# EasyEDA Pro project ProPrj_Avaota A1 八核 AIoT 开发板_2024-05-03.epro, board 点位_TOP (continued)
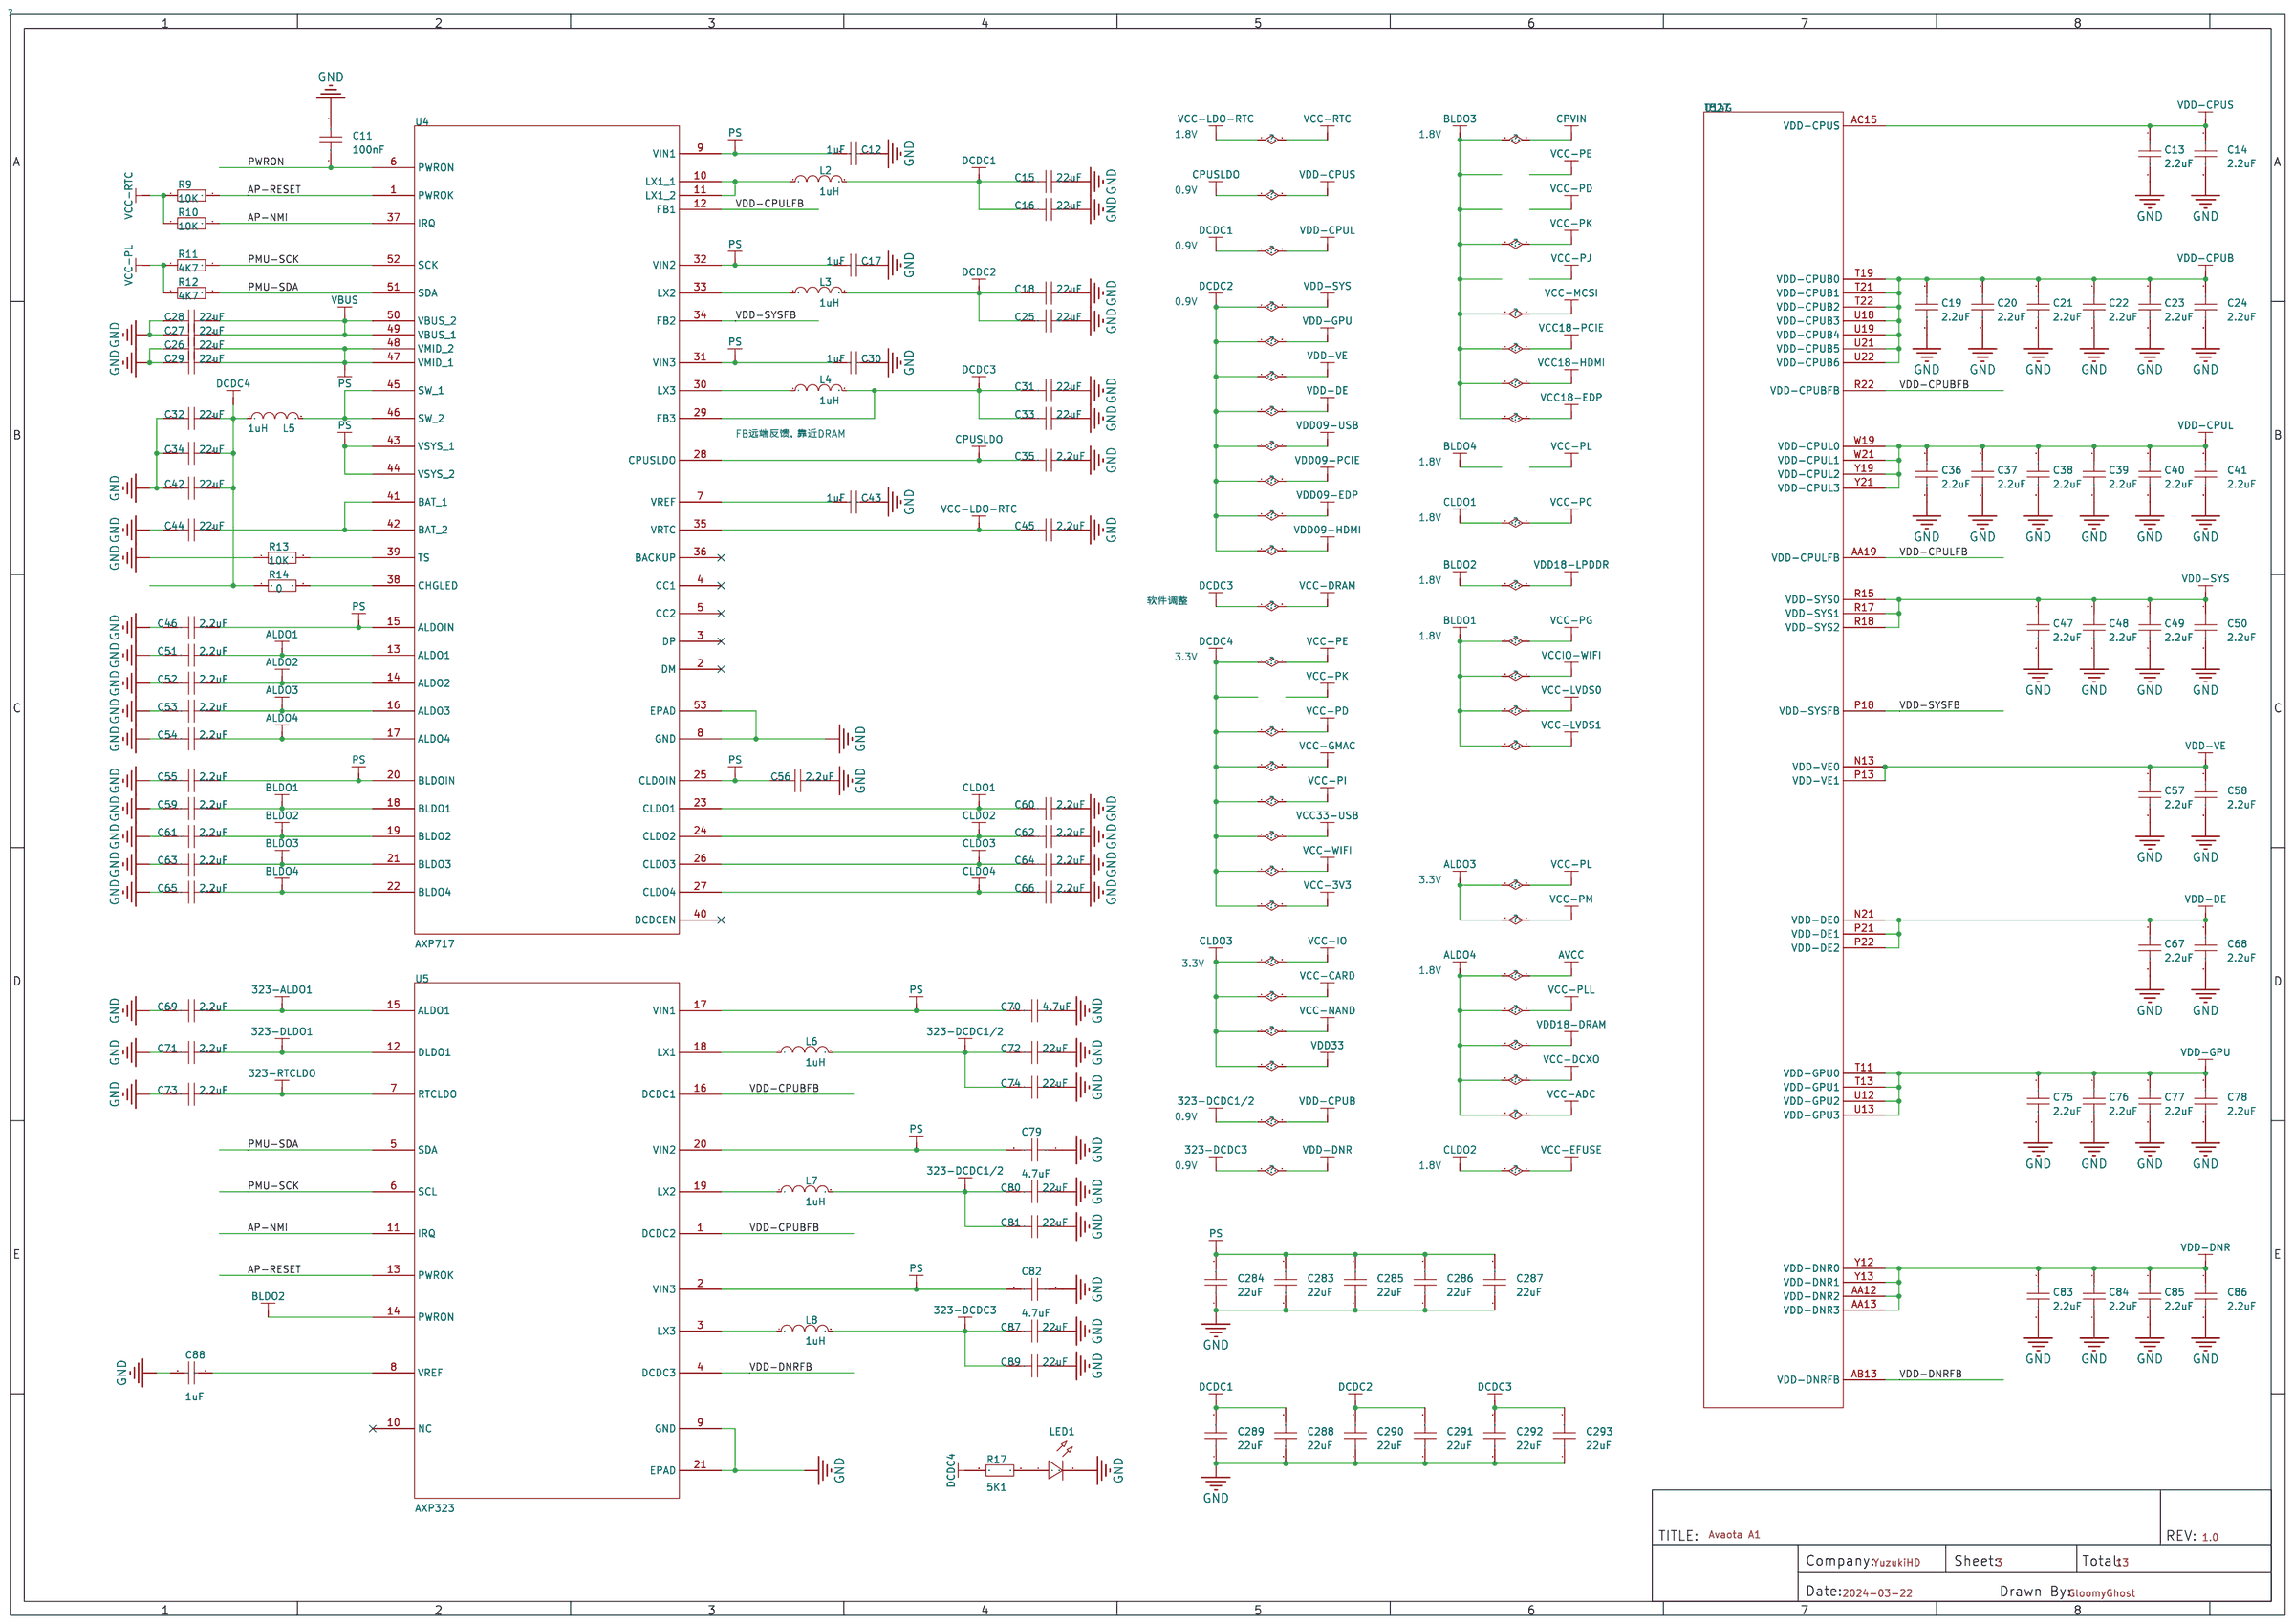
[diagram p0: POWER]
## Routing (per net, layer and track width the routed paths; a pad name or vN(x,y) marks a point on that pad's centre or on a via; arc(x,y) is an arc through that point) (continued)
  Bottom Layer w0.508: 96.44,25.28 96.44,23.84 96.29,23.69
  Bottom Layer w0.762: RJ1.SHIELD0 75.2,9.49 RJ2.SHIELD1 RJ2.SHIELD0 91.06,11.88 RJ2.P10 ; RJ1.SHIELD0 RJ1.SHIELD1 ; RJ1.SHIELD0 72.79,11.9 RJ1.P10
  vias: v1(51.74,47.73) v2(6.6,65.96) v2(6.6,65.18) v2(6.66,64.47) v2(6.66,63.88) v2(6.76,66.5) v2(6.68,63.04) v2(6.68,62.26) v2(7.04,61.75) v2(7.24,66.68) v2(7.49,52.96) v2(7.49,52.25) v2(7.49,51.46) v2(7.49,50.7) v2(7.9,61.62) v2(8.13,66.75) v2(8.31,52.96) v2(8.31,52.25) v2(8.31,51.46) v2(8.31,50.7) v2(8.81,61.62) v2(8.94,66.8) v2(9.12,52.96) v2(9.12,52.25) v2(9.12,51.46) v2(9.47,38.53) v2(9.78,61.7) v2(9.93,66.5) v2(9.93,52.96) v2(9.93,52.25) v2(9.93,51.46) v2(10.16,65.58) v2(10.46,62.15) v2(10.67,66.27) v2(10.59,63.32) v2(10.77,65.51) v2(10.97,62.66) v2(11.13,63.6) v2(11.46,65.48) v2(11.51,63.02) v2(11.61,66.17) v2(11.61,64.77) v2(11.91,63.63) v2(12.12,65.51) v2(12.14,64.74) v2(12.17,63.02) v2(12.5,63.65) v2(12.85,65.43) v2(12.93,62.99) v2(13.16,64.77) v2(13.33,63.7) v2(13.51,65.46) v2(13.59,63.02) v2(13.94,64.74) v2(14,63.73) v2(14.27,65.46) v2(14.43,63.02) v2(14.55,64.77) v2(14.6,63.7) v2(20.96,59.26) v2(22.22,59.26) v2(28.7,18.81) v2(57.78,26.26) v2(62.2,20.54) v2(65.38,23.56) v2(65.38,22.85) v2(65.38,22.06) v2(65.38,21.3) v2(66.19,23.56) v2(66.19,22.85) v2(66.19,22.06) v2(66.19,21.3) v2(67.01,23.56) v2(67.01,22.85) v2(67.01,22.06) v2(67.01,21.3) v2(67.82,23.56) v2(67.82,22.85) v2(67.82,22.06) v2(67.82,21.3) v2(69.37,37.9) v2(69.8,37.11) v2(71.25,34.65) v2(72.87,34.21) v2(73.46,35.66) v2(73.63,33.12) v2(73.63,31.72) v2(75.08,36.35) v2(79.3,49.78) v2(80.75,20.38) v2(83.54,23.29) v2(83.54,22.58) v2(83.54,21.79) v2(83.54,21.03) v2(84.35,23.29) v2(84.35,22.58) v2(84.35,21.79) v2(84.35,21.03) v2(85.16,23.29) v2(85.16,22.58) v2(85.16,21.79) v2(85.16,21.03) v2(85.98,23.29) v2(85.98,22.58) v2(85.98,21.79) v2(85.98,21.03) v2(90.68,36.47) v3(15.85,43.49) v3(16.71,43.49) v3(16.71,42.61) v3(58.23,56.63) v3(70.18,45.3) v3(75.64,4.19) v3(76.33,1.14) v3(76.89,4.19) v3(85.47,54.43) v3(85.47,53.85) v3(85.83,57) v3(85.83,56.41)
VBUS: length 326.8
  Top Layer w0.127: v3(39.57,23.47) 39.73,23.62 41.76,23.62 ; R52.1 41.48,23.34 41.76,23.62 ; 41.76,23.62 42.27,23.62 42.54,23.34 R53.1
  Top Layer w0.152: C222.2 39.5,24.18
  Top Layer w0.203: D9.2 v3(39.57,22.25)
  Top Layer w0.254: LED2.4 v2(1.85,16.28) 1.85,14.58 2.34,14.09 LED3.4 1.68,13.15 1.68,11.89 2.42,11.14 LED4.4 1.7,10.22 1.7,8.79 2.3,8.19 LED5.4
  Top Layer w0.508: v2(17.22,36.58) v2(17.22,36.07) 17.22,35.06 D1.2 ; v3(96.72,66.88) v3(96.27,66.88) C280.2 94.27,66.88 U17.5
  内层4 w0.508: v2(97.61,22.25) 97.61,22.78 95.86,24.54 80.87,24.54 78.66,22.33 74.88,22.33 73.13,24.08 68.91,24.08 68.05,24.94 61.95,24.94 60.83,23.83 59.41,23.83 57.38,21.79 51.33,21.79 50.14,20.6 42.01,20.6 v2(38.49,17.08) v2(38.16,16.75)
  Inner5 w0.508: H1.4 H1.2 6.22,71.55 6.22,69.93 ; v2(1.85,16.28) 3.81,18.24 3.81,19.1 ; v3(96.72,66.88) v3(96.27,66.88) 95.81,66.42 95.81,62.92 96.29,62.43 96.29,55.91 95.05,54.66 95.05,51.16 95.71,50.5 95.71,48.46 97.61,46.56 v2(97.61,22.25)
  Inner5 w1.27: v4(9.93,43.59) 9.19,43.59 5.89,40.28 ; v4(9.93,43.59) 9.58,43.23 9.58,42.37 ; v4(9.93,43.59) 10.74,43.59 v4(10.77,43.56) ; v4(9.93,43.59) 10.24,43.28 10.24,43.15 ; 6.22,69.93 6.22,68.65 2.9,65.32 ; v4(10.77,43.56) v4(10.77,42.7) 10.77,42.67 10.79,42.65 8.43,40.28 ; v4(10.77,43.56) 9.58,42.37 ; 8.43,40.28 7.49,40.28 ; 8.43,40.28 7.39,39.24 v2(7.39,37.44) ; 5.89,40.28 5.77,40.28 3.2,37.72 ; 5.89,40.28 7.49,40.28 ; 3.2,37.72 2.69,38.21 ; 3.2,37.72 3.2,20.17 4.14,19.23 4.14,16 6.5,13.64 17.48,13.64 18.59,14.76 22.1,14.76 ; 21.89,14.91 22.71,15.72 35.79,15.72 36.47,15.04 ; 2.9,65.32 2.9,65.46 2.87,65.48 ; 2.9,65.32 2.9,55.45 2.15,54.71 2.15,51.95 2.49,51.61 2.49,38.3 ; 9.58,42.37 9.58,41.96 ; 9.58,42.37 7.49,40.28
  Bottom Layer w0.203: v3(39.57,22.25) v3(39.57,23.47)
  Bottom Layer w0.254: v2(7.39,37.44) 7.05,37.78 5.51,37.78 ; v2(7.39,37.44) 7.39,37.97 ; v2(7.39,37.44) 7.23,37.28 5.51,37.28
  Bottom Layer w0.508: v3(39.57,22.25) 39.57,18.16 v2(38.49,17.08) ; USB2.10 26.01,9.96 26.01,7.71 USB2.1 ; v2(97.61,22.25) 97.61,23.64 97.56,23.69 97.56,25.18 97.46,25.28 ; v2(38.16,16.75) v2(36.65,15.24) 36.45,15.04 v2(36.24,14.83)
  Bottom Layer w0.762: 12.31,41.46 15.85,37.92 16.61,37.92 17.22,37.31 v2(17.22,36.58) v2(17.22,36.07) ; 12.31,41.46 12.31,41.51 12.19,41.63 ; 12.31,41.46 12.19,41.58 12.19,41.63 ; 12.19,41.63 11.84,41.63 v4(10.77,42.7) v4(10.77,43.56) 11.13,43.56 12.19,42.49 12.19,41.63
  Bottom Layer w1.27: USB2.1 25.53,5.3 28.93,1.91 36.6,1.91 38.15,3.45 38.15,13.34 36.35,15.15
  vias: v2(4.62,50.32) v2(35.89,15.52) v2(36.98,14.66) v3(4.12,50.29) v3(4.12,49.76) v3(4.12,49.23) v3(4.12,48.66) v3(5.13,50.37) v4(9.09,43.6) v4(9.88,42.79)
VBUS-USB: length 13.7
  Top Layer w0.152: U17.1 91.97,68.11 R120.2
  Top Layer w0.508: USB3.B4A9 83.2,69.43 83.52,69.75 84.61,69.75 84.89,70.03 85.98,70.03 86.33,69.67 87.71,69.67 88.1,69.28 USB3.A4B9 88.1,67.81 89.09,66.82 C282.2 C281.2 90.59,66.86 U17.1
VCC-3V3-BLK: length 2.1
  Bottom Layer w0.254: 88.72,47.76 88.72,47.76 88.72,46.38 88.77,46.33 89.41,46.33
VCC-LDO-RTC: length 72.5
  Top Layer w0.152: R10.1 7.85,47.32 7.49,46.96 6.4,46.96 v3(6.27,47.09) R9.1
  Top Layer w0.203: U14.AE13 57.44,50.18 v2(57.94,50.67) ; C45.2 5.36,55.91 5.77,55.5 7.52,55.5 7.86,55.15 U4.35
  内层2 w0.152: v2(6.4,50.24) 6.27,50.11 v3(6.27,47.09)
  Inner5 w0.381: v2(14.53,53.95) 14.22,53.95 13.59,54.58 12.55,54.58 12.42,54.71 6.55,54.71 v2(5.47,55.79)
  Bottom Layer w0.152: v2(5.47,55.79) 5.82,55.45 6.88,55.45 7.04,55.3 7.04,50.88 v2(6.4,50.24)
  Bottom Layer w0.203: v2(14.53,53.95) 16.08,55.5 47.29,55.5 51.55,51.24 57.37,51.24 v2(57.94,50.67)
VDD-CPUBFB: length 70.8
  Top Layer w0.203: U5.16 17.66,41.87 v3(17.65,41.86) ; v3(17.37,44.68) 17.31,44.68 U5.1
  内层2 w0.254: v2(62.44,45.65) 63.12,45.65 63.96,46.48 63.96,46.79 63.37,47.37 63.37,49.07 62.31,50.14 61.72,50.14 61.49,50.37 61.49,50.88 61.95,51.33 61.95,52.02 61.9,52.02 61.29,52.63 61.29,53.49 60.88,53.9 59.82,53.9 57.18,56.54 56.57,56.54 55.63,57.48 55.63,57.84 52.58,60.88 31.9,60.88 27.1,56.08 27.1,53.19 18.59,44.68 v3(17.37,44.68)
  Bottom Layer w0.254: v3(17.65,41.86) 17.65,42.88 18.26,43.49 18.26,44.22 17.81,44.68 v3(17.37,44.68)
VDD-CPULFB: length 62
  Top Layer w0.254: v3(10.69,48.29) 10.66,48.31 U4.12
  Inner5 w0.254: v3(10.69,48.29) 10.39,47.98 10.39,45.85 11.38,44.86 13.61,44.86 17.93,49.17 25.6,49.17 32.56,56.13 46.25,56.13 51.23,51.16 51.82,51.16 52.1,50.88 52.1,50.29 52.68,49.71 53.62,49.71 54.15,49.17 57.61,49.17 57.94,48.84 58.42,48.84 58.85,48.41 58.85,47.42 59.13,47.14 v2(59.44,47.14)
VDD-DNRFB: length 52.6
  Top Layer w0.203: U5.4 15.85,44.8 15.65,45.01 15.65,45.75 15.47,45.92 v2(15.34,45.92)
  VCC w0.254: v2(15.34,45.92) 15.8,46.38 22.4,46.38 31.88,55.85 45.85,55.85 52.48,49.23 58.02,49.23 v2(58.94,50.15)
VDD-SYSFB: length 65.8
  Top Layer w0.203: U4.34 8.26,54.37 v3(8.05,54.15)
  Top Layer w0.254: v2(62.94,48.16) 62.94,47.65
  内层4 w0.254: v3(8.05,54.15) 8.05,56.01 9.09,57.05 9.09,58.29 10.85,60.05 13.94,60.05 14.55,59.44 16.87,59.44 20.07,56.24 45.47,56.24 52.55,49.15 58.75,49.15 60.27,47.62 62.56,47.62 62.94,48.01 v2(62.94,48.16)
323-ALDO1: length 0.8
  Top Layer w0.203: C69.1 17.05,40.9 U5.15
323-DCDC1/2: length 10.9
  Top Layer w0.203: v2(61.44,46.66) 61.95,46.66 ; v2(61.44,46.66) v2(60.93,46.66) 60.96,46.63 v2(60.96,46.15) ; v2(61.44,46.66) U14.U21 ; 61.95,46.66 61.95,47.14 U14.T19 ; 61.95,46.66 61.95,46.15 U14.T21 ; 61.44,46.66 U14.U19 U14.U18
  Bottom Layer w0.254: v2(61.94,45.65) 61.95,45.64 61.95,45.12 62.5,45.12 62.51,45.14 ; v2(61.94,45.65) 61.94,46.94 61.93,46.95 61.37,46.95 61.44,46.88 v2(61.44,46.66) ; v2(61.94,45.65) v2(61.44,45.65) ; v2(61.44,45.65) 61.44,45.12 ; v2(61.44,45.65) v2(61.44,46.66) ; v2(61.44,46.66) v2(60.93,46.66) 60.96,46.63 v2(60.96,46.15) 60.96,45.71 60.9,45.64
  vias: v3(21.97,45.01) v3(21.97,44.36) v3(21.97,43.69) v3(21.97,43.05) v3(21.97,42.48) v3(21.97,41.76) v3(22.05,41.05) v3(22.57,41.05)
323-DCDC3: length 5.1
  Top Layer w0.254: U14.AA12 v2(59.44,50.15) v2(59.44,49.64) ; U14.Y12 v2(59.94,50.15) v2(59.94,49.64)
  Bottom Layer w0.254: v2(59.94,49.64) 59.77,49.46 59.39,49.46 ; v2(59.94,49.64) 59.94,49.53 59.87,49.46 ; v2(59.94,49.64) v2(59.94,50.15) ; v2(59.94,49.64) 60.12,49.46 60.38,49.46 ; 58.91,49.46 59.39,49.46 ; 59.39,49.46 59.44,49.51 v2(59.44,49.64) v2(59.44,50.15)
  vias: v3(18.21,48.49) v3(18.21,47.89) v3(18.73,47.89) v3(18.72,47.34)
323-DLDO1: length 0.8
  Top Layer w0.203: C71.1 15.85,40.91 U5.12
323-RTCLDO: length 1.1
  Top Layer w0.203: C73.1 14.1,43.61 14.3,43.41 14.84,43.41 U5.7
ADCIN0: length 4.1
  Bottom Layer w0.152: 60.15,55.42 60.67,55.42 60.71,55.46 60.83,55.33 60.83,52.54
  Bottom Layer w0.178: v3(60.44,52.15) 60.83,52.54
ADCIN1: length 4.7
  Bottom Layer w0.178: 61.32,55.98 61.28,55.94 61.28,55.21 61.14,55.07 61.14,52.27 60.51,51.65 v3(60.44,51.65)
ALDO1: length 2.5
  Top Layer w0.203: C51.1 12.75,47.83 12.32,48.26 11.38,48.26 11.07,48.57 11.07,48.9 U4.13
ALDO2: length 2
  Top Layer w0.203: U4.14 11.58,49.07 11.96,48.69 12.35,48.69 12.63,48.41 C52.1
ALDO3: length 80
  Top Layer w0.152: R12.1 R11.1 v3(5.18,47.12)
  Top Layer w0.203: v2(12.92,49.53) 12.73,49.53 12.03,50.23 U4.16
  Top Layer w0.254: v2(56.44,52.15) U14.AE11
  Top Layer w0.457: v2(49.53,61.54) 49.53,61.57 v2(49.15,61.95) 49.05,62.05 v2(42.11,62.05) v2(41.5,62.05)
  VCC w0.152: v2(12.92,49.53) 12.47,49.97 12.47,52.35 11.96,52.86 11.96,53.75 11.13,54.58 7.39,54.58 6.81,54 6.81,50.09 6.43,49.71 6.43,49.3 6.58,49.15 6.58,48.06 5.99,47.47 5.53,47.47 v3(5.18,47.12)
  Inner5 w0.457: v2(12.92,49.53) 12.57,49.53 12.14,49.96 12.14,51.21 12.73,51.79 13.37,51.79 14.79,53.21 18.62,53.21 20.6,55.19 22.92,55.19 29.78,62.05 v2(41.5,62.05)
  Bottom Layer w0.254: v2(56.44,52.15) 56.44,52.5 55.45,53.49 55.45,53.85 55.19,54.1 54.91,54.1 54.79,54.23 54.15,54.23 53.92,54 53.62,54 52.15,55.47 52.15,56.11 50.6,57.66 50.6,59.08 49.5,60.17 49.5,61.52 v2(49.53,61.54)
ALDO4: length 103.6
  Top Layer w0.102: v3(56.97,59.79) R32.2 ; v3(58.67,59.84) R30.2 ; 60.35,59.37 R19.2 ; 60.35,59.37 R31.2 v3(59.79,59.82) ; 60.35,59.37 60.91,59.37 R20.2
  Top Layer w0.203: v2(12.92,50.09) 12.84,50.17 12.6,50.17 12.14,50.63 U4.17 ; U14.AD15 U14.AG15 ; v3(60.44,53.15) 59.95,52.65 59.26,52.65 58.94,52.34 U14.AB9
  Top Layer w0.254: U14.AG15 56.44,49.14 v2(56.44,48.62)
  内层2 w0.254: v3(56.97,59.79) 56.97,59.56 57.25,59.28 58.22,59.28 58.67,59.74 v3(58.67,59.84)
  VCC w0.381: v2(56.44,48.62) 56.74,48.62 57.2,48.16 57.74,48.16 58.93,49.35 ; 58.93,49.35 58.93,45.36 58.72,45.16 58.19,45.16 57.94,44.91 v3(57.94,44.15) ; 58.93,49.35 59.21,49.07 60.35,49.07 60.93,49.66 v2(60.93,51.43) 60.93,52.65 v3(60.44,53.15) 59.68,53.15 58.85,53.98 58.85,57 58.39,57.46 58.39,58.47 58.67,58.75 v3(58.67,59.84) 58.67,60.05 58.98,60.35 59.46,60.35 59.79,60.02 v3(59.79,59.82)
  Inner5 w0.457: 12.92,50.09 12.92,50.09 13.39,50.09 13.87,50.57 13.87,51.26 15.09,52.48 18.77,52.48 ; 18.85,52.53 20.8,54.48 23.3,54.48 30.11,61.29 45.82,61.29 48.77,58.34 54.53,58.34 56.87,56.01 58.7,56.01 60.44,54.26 v3(60.44,53.15)
  Bottom Layer w0.127: 59.86,51.59 60.19,51.26 60.76,51.26 v2(60.93,51.43)
  Bottom Layer w0.152: v3(60.44,53.15) 60.44,53.2 59.72,53.92
  Bottom Layer w0.203: 59.72,53.34 60.25,53.34 v3(60.44,53.15)
  Bottom Layer w0.254: 57.94,44.02 57.94,43.67 57.94,43.66 ; 57.94,44.02 v3(57.94,44.15) ; 57.94,44.02 57.63,43.71 57.21,43.71 56.7,44.22 52.72,44.22 52.58,44.37 ; v2(56.44,48.62) 56.44,48.71 56.24,48.91 56.24,49.73 ; 52.58,44.37 52.55,44.34 ; 52.58,44.37 51.62,44.37 51.61,44.36
ALDO-OUT: length 0.4
  Bottom Layer w0.178: v3(57.44,53.15) 57.43,53.14 57.43,53.14 57.43,53.54
AP-NMI: length 84.4
  Top Layer w0.076: 53.04,51.4 53.7,51.4
  Top Layer w0.102: 53.7,51.4 53.94,51.65 U14.AM10 ; v3(52.81,51.63) 53.04,51.4
  Top Layer w0.127: U5.11 15.3,41.76 v3(13.41,41.76)
  Top Layer w0.152: U4.37 7.06,54.37 7.23,54.2 7.44,54.2 v2(7.57,54.08) ; v2(7.39,48.01) 7.79,48.01 R10.2
  VCC w0.102: v2(7.44,49.58) 7.07,49.96 7.07,53.57 v2(7.57,54.08)
  VCC w0.152: v2(7.44,49.58) 7.39,49.53 v2(7.39,48.01)
  Bottom Layer w0.102: v3(13.41,41.76) 13.28,41.88 13.28,43.41 12.27,44.42 6.66,44.42 5.28,45.8 5.28,46.43 4.8,46.91 4.8,47.4 5.26,47.85 5.26,48.03 4.52,48.77 4.52,49.53 4.98,49.99 5.77,49.99 6.53,49.23 7.09,49.23 v2(7.44,49.58) 7.77,49.91 9.09,49.91 9.6,50.42 11.71,50.42 11.91,50.62 11.91,55.17 13.59,56.85 35.69,56.85 36.37,57.53 42.27,57.53 43.84,55.96 47.65,55.96 51.99,51.61 52.79,51.61 v3(52.81,51.63)
  Bottom Layer w0.254: v3(52.81,51.63) 53.28,51.63 53.31,51.66
AP-RESET: length 85.4
  Top Layer w0.102: U4.1 6.26,49.11 6.76,49.61 v2(6.86,49.61)
  Top Layer w0.127: U5.13 16.25,41.03 v3(16.26,41.02)
  Top Layer w0.152: v2(22.78,38.89) 23.36,38.89 R21.2 ; U4.1 6.27,48.9 R9.2 6.77,47.97 C95.2
  Top Layer w0.254: U14.AJ11 55.45,51.15 v3(55.45,51.64)
  VCC w0.127: v2(14.6,44.3) 14.5,44.2 8.84,44.2 6.83,46.2 6.83,49.58 v2(6.86,49.61)
  VCC w0.152: v2(22.78,38.89) 17.83,38.89 16.26,40.46 v3(16.26,41.02)
  Bottom Layer w0.102: v2(6.86,49.61) 7.44,50.19 9.04,50.19 9.47,50.62 11.48,50.62 11.68,50.83 11.68,55.4 13.41,57.12 35.51,57.12 36.25,57.86 42.37,57.86 43.99,56.24 47.78,56.24 52.15,51.87 52.55,51.87 52.65,51.97 52.7,51.97 52.88,52.15 54.66,52.15 55.14,51.66 55.4,51.66
  Bottom Layer w0.127: v2(14.6,44.3) 14.6,42.67 v3(16.26,41.02)
AP-WAKE-BT: length 52.7
  Top Layer w0.102: v3(61.95,54.65) U14.U4
  Top Layer w0.203: 15.72,60.6 15.61,60.5 R69.2
  Top Layer w0.254: v3(17.02,60.53) U9.6
  Inner5 w0.102: v3(17.02,60.53) 17.6,59.94 19.3,59.94 22.07,62.71 45.14,62.71 48.97,58.88 55.07,58.88 56.34,57.61 57.84,57.61 60.8,54.65 v3(61.95,54.65)
AXP717-CC1: length 3.9
  Top Layer w0.102: R130.2 86.98,65.04 86.66,65.35 86.66,66.43 D24.2
  Top Layer w0.127: 87.07,66.86 87.07,67.44 86.92,67.59 86.92,68.53 USB3.A5
AXP717-CC2: length 2.8
  Top Layer w0.102: R129.2 83.11,66.92 D31.2
  Top Layer w0.127: USB3.B5 83.9,67.6 D31.2 83.13,66.84
BLDO1: length 99.3
  Top Layer w0.152: U14.N9 v3(63.44,52.58) ; U14.T9 62.08,52.15 62.46,52.53 v3(62.46,52.68)
  Top Layer w0.203: v2(12.92,50.65) 12.62,50.65 12.24,51.03 U4.18
  Top Layer w0.254: C179.2 C180.2 14.12,61.71 v2(14.12,61.19) 14.12,60.53 ; 14.12,60.53 14.12,59.91 R70.1 ; 14.12,60.53 R69.1
  Top Layer w0.508: U9.22 26.04,56.66 v2(24.71,57.99)
  VCC w0.381: v2(56.92,53.62) 56.44,53.14 54.2,53.14 53.75,53.59
  VCC w0.508: 53.75,53.7 47.29,60.15 30.4,60.15 v2(28.68,58.42) 24.94,54.69 14.49,54.69 13.99,54.18 13.99,51.25 13.39,50.65 v2(12.92,50.65)
  Inner5 w0.254: 62.07,52.15 62.46,52.54 v3(62.46,52.68) ; 62.07,52.15 61.87,52.15 ; 62.07,52.15 63.12,52.15 63.44,52.47 v3(63.44,52.58) ; 61.87,52.15 61.42,52.15 60.91,52.65 58.22,52.65 57.91,52.96 57.91,53.31 57.51,53.72 57.02,53.72 v2(56.92,53.62) ; 61.87,52.15 62.66,51.36 62.99,51.36 64.21,50.14 64.57,50.14 64.9,49.81 64.9,47.5 64.44,47.04 64.44,44.88 64.08,44.53 63.55,44.53 v2(63.42,44.65)
  Bottom Layer w0.254: 63.45,53.16 63.45,52.58 v3(63.44,52.58) ; 63.88,44.15 63.32,44.15 63.32,44.55 v2(63.42,44.65) ; 56.44,54.46 56.44,53.95 56.77,53.62 v2(56.92,53.62)
  Bottom Layer w0.508: v2(28.68,58.42) 25.15,58.42 v2(24.71,57.99) 17.81,57.99 14.6,61.19 v2(14.12,61.19)
BLDO2: length 52
  Top Layer w0.102: 35.81,50.05 v1(35.46,49.7)
  Top Layer w0.127: v3(16.64,40.64) 16.65,40.66 U5.14
  Top Layer w0.203: U4.19 12.3,51.43 12.5,51.23 12.89,51.23 v2(12.92,51.21)
  Top Layer w0.254: 33.41,50.7 v1(33.1,50.39) 33.07,50.39 32.37,51.09 32.23,51.09 32.23,51.71 ; v1(39.39,50.32) 39.54,50.32 39.81,50.05 ; 42.21,43.55 42.15,43.55 v1(41.81,43.21) ; v1(39.38,43.77) 39.4,43.77 39.81,44.18 39.81,44.2 ; 32.23,43.71 32.7,43.71 v1(32.87,43.55) 33.41,43.55 ; v1(36.23,43.96) 36.23,43.96 36.22,43.97 36.04,43.97 35.81,44.2
  Top Layer w0.305: 42.21,50.7 41.87,50.37 41.84,50.37 v1(41.83,50.36)
  内层4 w0.508: v1(33.1,50.39) 32.48,50.39 31.57,49.48 17.83,49.48 15.75,51.56 v2(15.06,51.56) 13.27,51.56 v2(12.92,51.21)
  Bottom Layer w0.152: v2(15.06,51.56) 14.48,50.98 14.48,45.36 15.06,44.78 15.06,42.8 16.64,41.22 v3(16.64,40.64)
  Bottom Layer w0.203: v1(39.38,43.77) 39.8,44.19 39.8,44.93 41.12,44.93 41.81,44.25 41.81,43.87
  Bottom Layer w0.254: 38.78,43.26 39.3,43.77 v1(39.38,43.77) ; v1(36.23,43.96) 35.99,44.2 35.99,44.4 ; v1(32.87,43.55) 32.83,43.55 ; 41.81,43.87 v1(41.81,43.21) ; v1(35.46,49.7) 35.45,49.7 35.02,49.28 34.39,49.28 34.16,49.51 34.16,49.96 33.78,50.34 33.14,50.34 v1(33.1,50.39)
BLDO3: length 84.1
  Top Layer w0.152: U14.AJ5 55.64,53.95 v3(55.93,53.95)
  Top Layer w0.203: v2(12.92,52.32) 12.57,52.32 12.48,52.23 U4.21
  Top Layer w0.254: U14.J15 65.46,49.16 64.96,49.66 64.45,49.66 ; v2(63.53,46.63) 63.94,46.22 U14.M21 ; U14.M10 63.96,51.63 v2(63.96,51.13) ; v2(63.96,45.09) 63.96,45.16 U14.L22 ; 64.45,49.66 U14.K13 ; 64.45,49.66 v2(64.44,49.66)
  内层2 w0.254: v2(70.36,52.73) 70,52.73 68.94,51.66 65.63,51.66 65.1,51.13 v2(63.96,51.13)
  VCC w0.381: v3(55.93,53.95) 55.75,54.13 54.1,54.13 47.4,60.83 30.1,60.83 24.56,55.3 14.25,55.3 13.41,54.46 13.41,52.82 v2(12.92,52.32)
  Bottom Layer w0.127: 64.06,47.55 64.36,47.55
  Bottom Layer w0.254: 64.41,45.03 64.01,45.03 v2(63.96,45.09) ; 69.08,53.39 69.08,52.81 70.28,52.81 v2(70.36,52.73) ; v3(55.93,53.95) 55.62,54.26 55.62,54.29
  Bottom Layer w0.381: 63.96,50.14 61.11,50.14 60.6,50.65 59,50.65 57.99,51.66 57.18,51.66 56.95,51.89 56.95,52.68 55.93,53.7 v3(55.93,53.95)
  Bottom Layer w0.457: 64.36,47.55 65,48.18 65,49.38 64.72,49.66 v2(64.44,49.66) 63.96,50.14 v2(63.96,51.13) ; v2(63.96,45.09) 63.83,45.21 63.83,46.33 v2(63.53,46.63) 63.63,46.63 64.52,47.52
BLDO4: length 1.4
  Top Layer w0.203: C65.1 12.55,52.86 12.32,52.63 U4.22
BOOT-SEL-ADC: length 4.3
  Top Layer w0.076: 60.42,56.18 60.07,56.44 59.83,57.33
  Top Layer w0.102: 59.83,57.33 59.83,58.3 59.59,58.55 58.98,58.55 58.67,58.85 ; 58.67,58.85 R30.1 ; 58.67,58.85 58.64,58.89 R33.2
BT-RESETN: length 45.6
  Top Layer w0.076: 61.44,55.14 61.19,55.39 61.19,56.38 61.18,56.38 60.96,56.79 60.91,57.23 60.93,57.78
  Top Layer w0.102: 60.93,57.76 60.93,58.11 61.49,58.67 61.49,59.72 60.99,60.22 56.64,60.22 54.86,58.45 36.14,58.45 v3(35.94,58.24) ; 26.06,66.45 v2(26.06,65.19)
  Bottom Layer w0.102: v3(35.94,58.24) 35.53,58.65 35.41,58.65 28.86,65.19 v2(26.06,65.19)
BT-WAKE-AP: length 54.8
  Top Layer w0.102: U14.U5 v3(61.95,54.15)
  Top Layer w0.203: 15.72,59.7 15.56,59.87 R70.2
  Top Layer w0.254: v3(17.5,60.71) 17.5,60.2 17.22,59.92 16.54,59.92 16.24,59.63 15.7,59.63
  Inner5 w0.102: v3(17.5,60.71) 17.5,60.5 17.81,60.2 19.15,60.2 22.02,63.07 45.19,63.07 49.07,59.18 55.14,59.18 56.44,57.89 57.96,57.89 60.86,54.99 62.1,54.99 62.31,54.79 62.31,54.5 v3(61.95,54.15)
CAN-RX0: length 116.6
  Top Layer w0.152: U14.AJ17 55.42,48.16 v3(55.42,48.59)
  内层2 w0.102: v2(45.39,57.76) 45.77,57.38 46,57.38 46.96,56.41 49.86,56.41 51.84,54.43 51.84,51.37 54.14,49.07 55.18,49.07 55.42,48.83 v3(55.42,48.59)
  内层4 w0.102: v2(44.17,64.85) 45.42,66.09 52.43,66.09 57.56,60.96 60.91,60.96 62.28,59.59 86.11,59.59 88.72,56.97 88.72,53.72 87.25,52.25 87.25,33.07 94.49,25.83 95.73,25.83 98.58,22.99 v2(98.58,21.51)
  Bottom Layer w0.102: v2(45.39,57.76) 45.57,57.94 45.57,58.95 44.4,60.12 44.4,63.91 44.17,64.14 v2(44.17,64.85) ; v2(98.58,21.51) 98.83,21.77 98.83,23.69
CAN-TX0: length 108.9
  Top Layer w0.152: v3(55.93,48.59) 55.93,48.16 U14.AH17
  内层2 w0.102: v2(45.97,57.79) 45.98,57.79 47.1,56.67 50.04,56.67 52.1,54.61 52.1,51.46 54.25,49.31 55.34,49.31 55.93,48.72 v3(55.93,48.59)
  内层4 w0.102: v2(44.7,64.82) 45.67,65.79 52.25,65.79 57.35,60.68 60.78,60.68 62.13,59.33 85.95,59.33 88.42,56.87 88.42,53.87 86.89,52.35 86.89,32.97 94.46,25.4 v2(94.84,25.4)
  Bottom Layer w0.102: 95.02,23.69 95.02,25.22 v2(94.84,25.4) ; v2(45.97,57.79) 45.97,59 44.7,60.27 v2(44.7,64.82)
CLDO1: length 79
  Top Layer w0.127: v3(35.59,34.52) 35.8,34.52 U8.P3 U8.N4 ; U8.N4 U8.M4 ; U8.N4 U8.P5
  Top Layer w0.203: v3(12.88,53.39) 12.6,53.39 12.24,53.03 U4.23
  Top Layer w0.254: U8.C6 41.58,33.3 v3(41.22,33.3)
  Bottom Layer w0.508: v3(61.44,43.64) 61.44,40.84 60.55,39.95 60.55,37.92 57.07,34.44 44.98,34.44 42.22,31.67 41.18,31.67 ; v3(41.22,33.3) 41.22,31.72 41.18,31.67 ; 41.18,31.67 36.3,31.67 35.59,32.39 v3(35.59,34.52) 35.59,34.93 35.03,35.48 20.62,35.48 13.79,42.32 13.79,52.48 v3(12.88,53.39)
CLDO2: length 117.3
  Top Layer w0.203: v2(12.92,53.95) 12.62,53.95 12.1,53.43 U4.24
  Top Layer w0.254: U14.R26 62.03,43.23 v2(62.03,41.91)
  VCC w0.254: v2(62.03,41.91) 62.03,38.53 57.36,33.87 38.59,33.87 37.39,32.66 37.39,29.52 34.39,26.52 31.75,26.52 25.78,20.55 21.62,20.55 21.16,20.09 7.44,20.09 3.7,23.83 3.7,50.46 5.96,52.72 5.96,53.91 7.68,55.64 11.57,55.64 12.92,54.29 v2(12.92,53.95)
  Bottom Layer w0.254: v2(62.03,41.91) 62.48,42.37 62.48,43.03 62.66,43.21
CLDO3: length 330.1
  Top Layer w0.127: v2(29.13,22.81) 30.84,22.81 34.66,18.99 R47.1
  Top Layer w0.203: v2(12.92,55.07) 12.67,55.07 11.84,54.23 11.58,54.23
  Top Layer w0.254: U8.K9 U8.J10 40.58,33.3 ; U8.E6 40.58,33.3 ; 40.58,33.3 40.58,33.48 U8.F5 39.6,33.32 v2(39.6,33.17)
  VCC w0.254: v2(56.73,65.81) 57.8,66.88 62.56,66.88 63.7,68.02 67.13,68.02 68.71,69.6 76.2,69.6 78.54,71.93 91.69,71.93 95.17,68.45 97.05,68.45 97.54,67.97 97.54,64.95 97.16,64.57 97.16,52.69 v3(96.11,51.65)
  VCC w0.381: v2(12.92,55.07) 13.23,55.07 14,55.83 24.23,55.83 29.87,61.47 47.52,61.47 52.12,56.87 53.34,56.87 54.18,56.03 56.93,56.03 57.4,55.56 57.4,54.15 57.94,53.62 57.94,52.65 U14.AC9
  VCC w0.508: v3(96.11,51.65) 95.68,51.22 95.68,44.76 90.2,39.27 90.2,38.18 91.54,36.83 91.54,29.57 90.55,28.58 v2(83.19,28.58) 82.7,28.58 v2(82.68,28.55) ; v2(12.92,55.07) 11.8,56.18 7.05,56.18 5.36,54.48 5.36,53.24 3.1,50.98
  VCC w0.635: v2(39.6,33.17) 39.6,27.38 39.57,27.36 58.62,27.36 v2(60.07,25.91) v2(60.53,25.91)
  VCC w0.762: 39.57,27.36 37.95,25.73 32.06,25.73 v2(29.13,22.81) 25.81,19.48 6.78,19.48 2.97,23.29 2.97,50.85 3.1,50.98
  Inner5 w0.508: v2(60.07,25.91) v2(60.53,25.91) 60.93,25.91 61.72,25.12 70.97,25.12 74.42,28.58 v2(83.19,28.58)
  Bottom Layer w0.152: 40.61,32.77 40,32.77 v2(39.6,33.17) ; v2(95.72,46.76) 95.72,47.78
  Bottom Layer w0.254: v2(39.6,33.17) 39.4,32.97 39.4,32.74 ; 57.38,66.27 57.19,66.27 v2(56.73,65.81) 56.41,65.49 ; 57.38,66.27 57.96,66.85 63.02,66.85 64.57,68.4 65.33,68.4 65.57,68.16 65.57,67.4 66.78,66.19 66.78,64.25 ; 57.38,66.27 57.28,66.17 ; 57.38,66.27 57.49,66.27 ; 58.12,52.15 v2(58.44,52.15) ; 95.22,50.76 v3(96.11,51.65) 96.11,55.25 96.88,56.01 96.88,57.12 98.56,58.81 98.81,58.81
CLDO4: length 2.2
  Top Layer w0.203: U4.27 11.51,55.19 12.34,55.19 12.6,55.45 12.79,55.45 C66.2
CPUSLDO: length 54.6
  Top Layer w0.203: U4.28 10.67,54.75 10.67,55.12 10.85,55.3 11.1,55.3 11.3,55.5 12.17,55.5 12.67,56.01 13.76,56.01 14.05,55.72 14.05,55.6 C35.2 14.22,55.58 15.14,54.66 v2(15.14,53.92) ; U14.AC15 v2(58.44,50.37)
  Bottom Layer w0.203: v2(58.44,50.37) 58.26,50.19 57.81,50.19 57.18,50.83 52.32,50.83 51.79,50.29 51.44,50.29 51.1,50.62 51.1,51.21 47.17,55.14 16.28,55.14 15.14,54 v2(15.14,53.92)
CPUX-RX: length 120.9
  Top Layer w0.127: D30.2 87.99,67.11 v2(87.66,67.43) 87.4,67.69 USB3.B8 ; v3(62.95,42.15) U14.R29
  内层2 w0.102: 87.66,67.44 86.61,68.48 82.91,68.48 82.17,67.74 64.21,67.74 63.55,68.4 20.22,68.4 19.33,69.29 19.33,71.96 H1.10
  VCC w0.102: v2(74.93,45.52) 74.93,47.8 80.42,53.29 80.42,65.3 82.45,67.34 83.59,67.34 84.23,66.7 87.25,66.7 87.66,67.11 v2(87.66,67.43)
  内层4 w0.102: v2(74.93,45.52) 74.73,45.52 73.89,44.68 71.07,44.68 69.9,43.51 66.6,43.51 66.09,43 63.81,43 v3(62.95,42.15)
CPUX-TX: length 115.9
  Top Layer w0.127: USB3.A8 84.4,67.19 D27.2 ; U14.R28 v3(62.95,42.64)
  内层2 w0.102: v2(84.4,67.34) 84.4,67.82 84,68.22 83.08,68.22 82.32,67.46 64.06,67.46 63.37,68.15 20.04,68.15 18.82,69.37 17.35,69.37 16.87,69.85 16.87,71.88 H1.8
  VCC w0.102: v2(74.42,45.8) 74.63,46 74.63,48.03 80.09,53.49 80.09,65.46 82.25,67.62 83.74,67.62 84.01,67.34 v2(84.4,67.34)
  内层4 w0.102: v2(74.42,45.8) 74.42,45.64 73.71,44.93 70.92,44.93 69.77,43.79 66.47,43.79 65.94,43.26 63.56,43.26 v3(62.95,42.64)
CPVDD: length 1.2
  Top Layer w0.152: U14.AJ3 v3(55.92,55.15)
  Bottom Layer w0.152: 55.93,55.85 55.92,55.85 v3(55.92,55.15)
CPVEE: length 3.3
  Top Layer w0.152: U14.AK2 54.94,55.64 v3(54.94,55.19) ; v3(55.92,54.65) U14.AJ4
  Bottom Layer w0.152: v3(55.92,54.65) 55.79,54.65 55.45,54.99 55.45,55.79 55.4,55.84 55.4,55.65 v3(54.94,55.19)
CTP-INT: length 72.6
  Top Layer w0.076: 62.79,40.39 62.78,40.39 ; 62.79,40.39 62.84,40.34 ; 62.79,40.39 62.69,40.48 62.69,40.9 62.44,41.15 ; 62.79,40.39 62.84,40.35 62.84,40.34 ; 62.84,40.34 62.85,40.18 62.85,40.11 62.85,40.09 62.85,39.94 62.75,39.83 62.75,38.31 62.78,38.17 62.92,37.94 63.11,37.67
  Top Layer w0.102: v3(63.35,36.42) 63.22,36.55 63.22,37.57 63.12,37.67
  Inner5 w0.127: v3(25.1,23.72) 25.43,24.05 25.43,29.29 28.6,32.46 42.57,32.46 45.21,35.1 60.93,35.1 62.26,36.42 v3(63.35,36.42)
  Bottom Layer w0.127: v3(25.1,23.72) 19.94,23.72 18.21,22 7.67,22 6.45,20.78 5.51,20.78
